# EAGLE board Resistor_Resistor (EAGLE 8.3.0), part 18 of 32
## Placement (x,y rotation side) (continued)
R21730  10K  [0201]  157.02,79.91 0 top
R21731  10K  [0201]  157.02,80.52 0 top
R21732  10K  [0201]  157.02,81.13 0 top
R21733  10K  [0201]  157.02,81.74 0 top
R21734  10K  [0201]  157.02,82.35 0 top
R21735  10K  [0201]  157.02,82.96 0 top
R21736  10K  [0201]  157.02,83.57 0 top
R21737  10K  [0201]  157.02,84.18 0 top
R21738  10K  [0201]  157.02,84.79 0 top
R21739  10K  [0201]  157.02,85.39 0 top
R21740  10K  [0201]  157.02,86 0 top
R21741  10K  [0201]  157.02,86.61 0 top
R21742  10K  [0201]  157.02,87.22 0 top
R21743  10K  [0201]  157.02,87.83 0 top
R21744  10K  [0201]  157.02,88.44 0 top
R21745  10K  [0201]  157.02,89.05 0 top
R21746  10K  [0201]  157.02,89.66 0 top
R21747  10K  [0201]  157.02,90.27 0 top
R21748  10K  [0201]  157.02,90.88 0 top
R21749  10K  [0201]  157.02,91.49 0 top
R21750  10K  [0201]  157.02,92.1 0 top
R21751  10K  [0201]  157.02,92.71 0 top
R21752  10K  [0201]  157.02,93.32 0 top
R21753  10K  [0201]  157.02,93.93 0 top
R21754  10K  [0201]  157.02,94.54 0 top
R21755  10K  [0201]  157.02,95.15 0 top
R21756  10K  [0201]  157.02,95.76 0 top
R21757  10K  [0201]  157.02,96.37 0 top
R21758  10K  [0201]  157.02,96.98 0 top
R21759  10K  [0201]  157.02,97.59 0 top
R21760  10K  [0201]  157.02,98.2 0 top
R21761  10K  [0201]  157.02,98.81 0 top
R21762  10K  [0201]  157.02,99.42 0 top
R21763  10K  [0201]  157.02,100.03 0 top
R21764  10K  [0201]  157.02,100.63 0 top
R21765  10K  [0201]  157.02,101.24 0 top
R21766  10K  [0201]  157.02,101.85 0 top
R21767  10K  [0201]  157.02,102.46 0 top
R21768  10K  [0201]  157.02,103.07 0 top
R21769  10K  [0201]  157.02,103.68 0 top
R21770  10K  [0201]  157.02,104.29 0 top
R21771  10K  [0201]  157.02,104.9 0 top
R21772  10K  [0201]  157.02,105.51 0 top
R21773  10K  [0201]  157.02,106.12 0 top
R21774  10K  [0201]  157.02,106.73 0 top
R21775  10K  [0201]  157.02,107.34 0 top
R21776  10K  [0201]  157.02,107.95 0 top
R21777  10K  [0201]  157.02,108.56 0 top
R21778  10K  [0201]  157.02,109.17 0 top
R21779  10K  [0201]  157.02,109.78 0 top
R21780  10K  [0201]  157.02,110.39 0 top
R21781  10K  [0201]  157.02,111 0 top
R21782  10K  [0201]  157.02,111.61 0 top
R21783  10K  [0201]  157.02,112.22 0 top
R21784  10K  [0201]  157.02,112.83 0 top
R21785  10K  [0201]  157.02,113.44 0 top
R21786  10K  [0201]  157.02,114.05 0 top
R21787  10K  [0201]  157.02,114.66 0 top
R21788  10K  [0201]  157.02,115.27 0 top
R21789  10K  [0201]  157.02,115.87 0 top
R21790  10K  [0201]  157.02,116.48 0 top
R21791  10K  [0201]  157.02,117.09 0 top
R21792  10K  [0201]  157.02,117.7 0 top
R21793  10K  [0201]  157.02,118.31 0 top
R21794  10K  [0201]  157.02,118.92 0 top
R21795  10K  [0201]  157.02,119.53 0 top
R21796  10K  [0201]  157.02,120.14 0 top
R21797  10K  [0201]  157.02,120.75 0 top
R21798  10K  [0201]  157.02,121.36 0 top
R21799  10K  [0201]  157.02,121.97 0 top
R21800  10K  [0201]  157.02,122.58 0 top
R21801  10K  [0201]  158.24,1.27 0 top
R21802  10K  [0201]  158.24,1.88 0 top
R21803  10K  [0201]  158.24,2.49 0 top
R21804  10K  [0201]  158.24,3.1 0 top
R21805  10K  [0201]  158.24,3.71 0 top
R21806  10K  [0201]  158.24,4.32 0 top
R21807  10K  [0201]  158.24,4.93 0 top
R21808  10K  [0201]  158.24,5.54 0 top
R21809  10K  [0201]  158.24,6.15 0 top
R21810  10K  [0201]  158.24,6.76 0 top
R21811  10K  [0201]  158.24,7.37 0 top
R21812  10K  [0201]  158.24,7.98 0 top
R21813  10K  [0201]  158.24,8.59 0 top
R21814  10K  [0201]  158.24,9.19 0 top
R21815  10K  [0201]  158.24,9.8 0 top
R21816  10K  [0201]  158.24,10.41 0 top
R21817  10K  [0201]  158.24,11.02 0 top
R21818  10K  [0201]  158.24,11.63 0 top
R21819  10K  [0201]  158.24,12.24 0 top
R21820  10K  [0201]  158.24,12.85 0 top
R21821  10K  [0201]  158.24,13.46 0 top
R21822  10K  [0201]  158.24,14.07 0 top
R21823  10K  [0201]  158.24,14.68 0 top
R21824  10K  [0201]  158.24,15.29 0 top
R21825  10K  [0201]  158.24,15.9 0 top
R21826  10K  [0201]  158.24,16.51 0 top
R21827  10K  [0201]  158.24,17.12 0 top
R21828  10K  [0201]  158.24,17.73 0 top
R21829  10K  [0201]  158.24,18.34 0 top
R21830  10K  [0201]  158.24,18.95 0 top
R21831  10K  [0201]  158.24,19.56 0 top
R21832  10K  [0201]  158.24,20.17 0 top
R21833  10K  [0201]  158.24,20.78 0 top
R21834  10K  [0201]  158.24,21.39 0 top
R21835  10K  [0201]  158.24,22 0 top
R21836  10K  [0201]  158.24,22.61 0 top
R21837  10K  [0201]  158.24,23.22 0 top
R21838  10K  [0201]  158.24,23.83 0 top
R21839  10K  [0201]  158.24,24.43 0 top
R21840  10K  [0201]  158.24,25.04 0 top
R21841  10K  [0201]  158.24,25.65 0 top
R21842  10K  [0201]  158.24,26.26 0 top
R21843  10K  [0201]  158.24,26.87 0 top
R21844  10K  [0201]  158.24,27.48 0 top
R21845  10K  [0201]  158.24,28.09 0 top
R21846  10K  [0201]  158.24,28.7 0 top
R21847  10K  [0201]  158.24,29.31 0 top
R21848  10K  [0201]  158.24,29.92 0 top
R21849  10K  [0201]  158.24,30.53 0 top
R21850  10K  [0201]  158.24,31.14 0 top
R21851  10K  [0201]  158.24,31.75 0 top
R21852  10K  [0201]  158.24,32.36 0 top
R21853  10K  [0201]  158.24,32.97 0 top
R21854  10K  [0201]  158.24,33.58 0 top
R21855  10K  [0201]  158.24,34.19 0 top
R21856  10K  [0201]  158.24,34.8 0 top
R21857  10K  [0201]  158.24,35.41 0 top
R21858  10K  [0201]  158.24,36.02 0 top
R21859  10K  [0201]  158.24,36.63 0 top
R21860  10K  [0201]  158.24,37.24 0 top
R21861  10K  [0201]  158.24,37.85 0 top
R21862  10K  [0201]  158.24,38.46 0 top
R21863  10K  [0201]  158.24,39.07 0 top
R21864  10K  [0201]  158.24,39.67 0 top
R21865  10K  [0201]  158.24,40.28 0 top
R21866  10K  [0201]  158.24,40.89 0 top
R21867  10K  [0201]  158.24,41.5 0 top
R21868  10K  [0201]  158.24,42.11 0 top
R21869  10K  [0201]  158.24,42.72 0 top
R21870  10K  [0201]  158.24,43.33 0 top
R21871  10K  [0201]  158.24,43.94 0 top
R21872  10K  [0201]  158.24,44.55 0 top
R21873  10K  [0201]  158.24,45.16 0 top
R21874  10K  [0201]  158.24,45.77 0 top
R21875  10K  [0201]  158.24,46.38 0 top
R21876  10K  [0201]  158.24,46.99 0 top
R21877  10K  [0201]  158.24,47.6 0 top
R21878  10K  [0201]  158.24,48.21 0 top
R21879  10K  [0201]  158.24,48.82 0 top
R21880  10K  [0201]  158.24,49.43 0 top
R21881  10K  [0201]  158.24,50.04 0 top
R21882  10K  [0201]  158.24,50.65 0 top
R21883  10K  [0201]  158.24,51.26 0 top
R21884  10K  [0201]  158.24,51.87 0 top
R21885  10K  [0201]  158.24,52.48 0 top
R21886  10K  [0201]  158.24,53.09 0 top
R21887  10K  [0201]  158.24,53.7 0 top
R21888  10K  [0201]  158.24,54.31 0 top
R21889  10K  [0201]  158.24,54.91 0 top
R21890  10K  [0201]  158.24,55.52 0 top
R21891  10K  [0201]  158.24,56.13 0 top
R21892  10K  [0201]  158.24,56.74 0 top
R21893  10K  [0201]  158.24,57.35 0 top
R21894  10K  [0201]  158.24,57.96 0 top
R21895  10K  [0201]  158.24,58.57 0 top
R21896  10K  [0201]  158.24,59.18 0 top
R21897  10K  [0201]  158.24,59.79 0 top
R21898  10K  [0201]  158.24,60.4 0 top
R21899  10K  [0201]  158.24,61.01 0 top
R21900  10K  [0201]  158.24,61.62 0 top
R21901  10K  [0201]  158.24,62.23 0 top
R21902  10K  [0201]  158.24,62.84 0 top
R21903  10K  [0201]  158.24,63.45 0 top
R21904  10K  [0201]  158.24,64.06 0 top
R21905  10K  [0201]  158.24,64.67 0 top
R21906  10K  [0201]  158.24,65.28 0 top
R21907  10K  [0201]  158.24,65.89 0 top
R21908  10K  [0201]  158.24,66.5 0 top
R21909  10K  [0201]  158.24,67.11 0 top
R21910  10K  [0201]  158.24,67.72 0 top
R21911  10K  [0201]  158.24,68.33 0 top
R21912  10K  [0201]  158.24,68.94 0 top
R21913  10K  [0201]  158.24,69.55 0 top
R21914  10K  [0201]  158.24,70.15 0 top
R21915  10K  [0201]  158.24,70.76 0 top
R21916  10K  [0201]  158.24,71.37 0 top
R21917  10K  [0201]  158.24,71.98 0 top
R21918  10K  [0201]  158.24,72.59 0 top
R21919  10K  [0201]  158.24,73.2 0 top
R21920  10K  [0201]  158.24,73.81 0 top
R21921  10K  [0201]  158.24,74.42 0 top
R21922  10K  [0201]  158.24,75.03 0 top
R21923  10K  [0201]  158.24,75.64 0 top
R21924  10K  [0201]  158.24,76.25 0 top
R21925  10K  [0201]  158.24,76.86 0 top
R21926  10K  [0201]  158.24,77.47 0 top
R21927  10K  [0201]  158.24,78.08 0 top
R21928  10K  [0201]  158.24,78.69 0 top
R21929  10K  [0201]  158.24,79.3 0 top
R21930  10K  [0201]  158.24,79.91 0 top
R21931  10K  [0201]  158.24,80.52 0 top
R21932  10K  [0201]  158.24,81.13 0 top
R21933  10K  [0201]  158.24,81.74 0 top
R21934  10K  [0201]  158.24,82.35 0 top
R21935  10K  [0201]  158.24,82.96 0 top
R21936  10K  [0201]  158.24,83.57 0 top
R21937  10K  [0201]  158.24,84.18 0 top
R21938  10K  [0201]  158.24,84.79 0 top
R21939  10K  [0201]  158.24,85.39 0 top
R21940  10K  [0201]  158.24,86 0 top
R21941  10K  [0201]  158.24,86.61 0 top
R21942  10K  [0201]  158.24,87.22 0 top
R21943  10K  [0201]  158.24,87.83 0 top
R21944  10K  [0201]  158.24,88.44 0 top
R21945  10K  [0201]  158.24,89.05 0 top
R21946  10K  [0201]  158.24,89.66 0 top
R21947  10K  [0201]  158.24,90.27 0 top
R21948  10K  [0201]  158.24,90.88 0 top
R21949  10K  [0201]  158.24,91.49 0 top
R21950  10K  [0201]  158.24,92.1 0 top
R21951  10K  [0201]  158.24,92.71 0 top
R21952  10K  [0201]  158.24,93.32 0 top
R21953  10K  [0201]  158.24,93.93 0 top
R21954  10K  [0201]  158.24,94.54 0 top
R21955  10K  [0201]  158.24,95.15 0 top
R21956  10K  [0201]  158.24,95.76 0 top
R21957  10K  [0201]  158.24,96.37 0 top
R21958  10K  [0201]  158.24,96.98 0 top
R21959  10K  [0201]  158.24,97.59 0 top
R21960  10K  [0201]  158.24,98.2 0 top
R21961  10K  [0201]  158.24,98.81 0 top
R21962  10K  [0201]  158.24,99.42 0 top
R21963  10K  [0201]  158.24,100.03 0 top
R21964  10K  [0201]  158.24,100.63 0 top
R21965  10K  [0201]  158.24,101.24 0 top
R21966  10K  [0201]  158.24,101.85 0 top
R21967  10K  [0201]  158.24,102.46 0 top
R21968  10K  [0201]  158.24,103.07 0 top
R21969  10K  [0201]  158.24,103.68 0 top
R21970  10K  [0201]  158.24,104.29 0 top
R21971  10K  [0201]  158.24,104.9 0 top
R21972  10K  [0201]  158.24,105.51 0 top
R21973  10K  [0201]  158.24,106.12 0 top
R21974  10K  [0201]  158.24,106.73 0 top
R21975  10K  [0201]  158.24,107.34 0 top
R21976  10K  [0201]  158.24,107.95 0 top
R21977  10K  [0201]  158.24,108.56 0 top
R21978  10K  [0201]  158.24,109.17 0 top
R21979  10K  [0201]  158.24,109.78 0 top
R21980  10K  [0201]  158.24,110.39 0 top
R21981  10K  [0201]  158.24,111 0 top
R21982  10K  [0201]  158.24,111.61 0 top
R21983  10K  [0201]  158.24,112.22 0 top
R21984  10K  [0201]  158.24,112.83 0 top
R21985  10K  [0201]  158.24,113.44 0 top
R21986  10K  [0201]  158.24,114.05 0 top
R21987  10K  [0201]  158.24,114.66 0 top
R21988  10K  [0201]  158.24,115.27 0 top
R21989  10K  [0201]  158.24,115.87 0 top
R21990  10K  [0201]  158.24,116.48 0 top
R21991  10K  [0201]  158.24,117.09 0 top
R21992  10K  [0201]  158.24,117.7 0 top
R21993  10K  [0201]  158.24,118.31 0 top
R21994  10K  [0201]  158.24,118.92 0 top
R21995  10K  [0201]  158.24,119.53 0 top
R21996  10K  [0201]  158.24,120.14 0 top
R21997  10K  [0201]  158.24,120.75 0 top
R21998  10K  [0201]  158.24,121.36 0 top
R21999  10K  [0201]  158.24,121.97 0 top
R22000  10K  [0201]  158.24,122.58 0 top
R22001  10K  [0201]  159.46,1.27 0 top
R22002  10K  [0201]  159.46,1.88 0 top
R22003  10K  [0201]  159.46,2.49 0 top
R22004  10K  [0201]  159.46,3.1 0 top
R22005  10K  [0201]  159.46,3.71 0 top
R22006  10K  [0201]  159.46,4.32 0 top
R22007  10K  [0201]  159.46,4.93 0 top
R22008  10K  [0201]  159.46,5.54 0 top
R22009  10K  [0201]  159.46,6.15 0 top
R22010  10K  [0201]  159.46,6.76 0 top
R22011  10K  [0201]  159.46,7.37 0 top
R22012  10K  [0201]  159.46,7.98 0 top
R22013  10K  [0201]  159.46,8.59 0 top
R22014  10K  [0201]  159.46,9.19 0 top
R22015  10K  [0201]  159.46,9.8 0 top
R22016  10K  [0201]  159.46,10.41 0 top
R22017  10K  [0201]  159.46,11.02 0 top
R22018  10K  [0201]  159.46,11.63 0 top
R22019  10K  [0201]  159.46,12.24 0 top
R22020  10K  [0201]  159.46,12.85 0 top
R22021  10K  [0201]  159.46,13.46 0 top
R22022  10K  [0201]  159.46,14.07 0 top
R22023  10K  [0201]  159.46,14.68 0 top
R22024  10K  [0201]  159.46,15.29 0 top
R22025  10K  [0201]  159.46,15.9 0 top
R22026  10K  [0201]  159.46,16.51 0 top
R22027  10K  [0201]  159.46,17.12 0 top
R22028  10K  [0201]  159.46,17.73 0 top
R22029  10K  [0201]  159.46,18.34 0 top
R22030  10K  [0201]  159.46,18.95 0 top
R22031  10K  [0201]  159.46,19.56 0 top
R22032  10K  [0201]  159.46,20.17 0 top
R22033  10K  [0201]  159.46,20.78 0 top
R22034  10K  [0201]  159.46,21.39 0 top
R22035  10K  [0201]  159.46,22 0 top
R22036  10K  [0201]  159.46,22.61 0 top
R22037  10K  [0201]  159.46,23.22 0 top
R22038  10K  [0201]  159.46,23.83 0 top
R22039  10K  [0201]  159.46,24.43 0 top
R22040  10K  [0201]  159.46,25.04 0 top
R22041  10K  [0201]  159.46,25.65 0 top
R22042  10K  [0201]  159.46,26.26 0 top
R22043  10K  [0201]  159.46,26.87 0 top
R22044  10K  [0201]  159.46,27.48 0 top
R22045  10K  [0201]  159.46,28.09 0 top
R22046  10K  [0201]  159.46,28.7 0 top
R22047  10K  [0201]  159.46,29.31 0 top
R22048  10K  [0201]  159.46,29.92 0 top
R22049  10K  [0201]  159.46,30.53 0 top
R22050  10K  [0201]  159.46,31.14 0 top
R22051  10K  [0201]  159.46,31.75 0 top
R22052  10K  [0201]  159.46,32.36 0 top
R22053  10K  [0201]  159.46,32.97 0 top
R22054  10K  [0201]  159.46,33.58 0 top
R22055  10K  [0201]  159.46,34.19 0 top
R22056  10K  [0201]  159.46,34.8 0 top
R22057  10K  [0201]  159.46,35.41 0 top
R22058  10K  [0201]  159.46,36.02 0 top
R22059  10K  [0201]  159.46,36.63 0 top
R22060  10K  [0201]  159.46,37.24 0 top
R22061  10K  [0201]  159.46,37.85 0 top
R22062  10K  [0201]  159.46,38.46 0 top
R22063  10K  [0201]  159.46,39.07 0 top
R22064  10K  [0201]  159.46,39.67 0 top
R22065  10K  [0201]  159.46,40.28 0 top
R22066  10K  [0201]  159.46,40.89 0 top
R22067  10K  [0201]  159.46,41.5 0 top
R22068  10K  [0201]  159.46,42.11 0 top
R22069  10K  [0201]  159.46,42.72 0 top
R22070  10K  [0201]  159.46,43.33 0 top
R22071  10K  [0201]  159.46,43.94 0 top
R22072  10K  [0201]  159.46,44.55 0 top
R22073  10K  [0201]  159.46,45.16 0 top
R22074  10K  [0201]  159.46,45.77 0 top
R22075  10K  [0201]  159.46,46.38 0 top
R22076  10K  [0201]  159.46,46.99 0 top
R22077  10K  [0201]  159.46,47.6 0 top
R22078  10K  [0201]  159.46,48.21 0 top
R22079  10K  [0201]  159.46,48.82 0 top
R22080  10K  [0201]  159.46,49.43 0 top
R22081  10K  [0201]  159.46,50.04 0 top
R22082  10K  [0201]  159.46,50.65 0 top
R22083  10K  [0201]  159.46,51.26 0 top
R22084  10K  [0201]  159.46,51.87 0 top
R22085  10K  [0201]  159.46,52.48 0 top
R22086  10K  [0201]  159.46,53.09 0 top
R22087  10K  [0201]  159.46,53.7 0 top
R22088  10K  [0201]  159.46,54.31 0 top
R22089  10K  [0201]  159.46,54.91 0 top
R22090  10K  [0201]  159.46,55.52 0 top
R22091  10K  [0201]  159.46,56.13 0 top
R22092  10K  [0201]  159.46,56.74 0 top
R22093  10K  [0201]  159.46,57.35 0 top
R22094  10K  [0201]  159.46,57.96 0 top
R22095  10K  [0201]  159.46,58.57 0 top
R22096  10K  [0201]  159.46,59.18 0 top
R22097  10K  [0201]  159.46,59.79 0 top
R22098  10K  [0201]  159.46,60.4 0 top
R22099  10K  [0201]  159.46,61.01 0 top
R22100  10K  [0201]  159.46,61.62 0 top
R22101  10K  [0201]  159.46,62.23 0 top
R22102  10K  [0201]  159.46,62.84 0 top
R22103  10K  [0201]  159.46,63.45 0 top
R22104  10K  [0201]  159.46,64.06 0 top
R22105  10K  [0201]  159.46,64.67 0 top
R22106  10K  [0201]  159.46,65.28 0 top
R22107  10K  [0201]  159.46,65.89 0 top
R22108  10K  [0201]  159.46,66.5 0 top
R22109  10K  [0201]  159.46,67.11 0 top
R22110  10K  [0201]  159.46,67.72 0 top
R22111  10K  [0201]  159.46,68.33 0 top
R22112  10K  [0201]  159.46,68.94 0 top
R22113  10K  [0201]  159.46,69.55 0 top
R22114  10K  [0201]  159.46,70.15 0 top
R22115  10K  [0201]  159.46,70.76 0 top
R22116  10K  [0201]  159.46,71.37 0 top
R22117  10K  [0201]  159.46,71.98 0 top
R22118  10K  [0201]  159.46,72.59 0 top
R22119  10K  [0201]  159.46,73.2 0 top
R22120  10K  [0201]  159.46,73.81 0 top
R22121  10K  [0201]  159.46,74.42 0 top
R22122  10K  [0201]  159.46,75.03 0 top
R22123  10K  [0201]  159.46,75.64 0 top
R22124  10K  [0201]  159.46,76.25 0 top
R22125  10K  [0201]  159.46,76.86 0 top
R22126  10K  [0201]  159.46,77.47 0 top
R22127  10K  [0201]  159.46,78.08 0 top
R22128  10K  [0201]  159.46,78.69 0 top
R22129  10K  [0201]  159.46,79.3 0 top
R22130  10K  [0201]  159.46,79.91 0 top
R22131  10K  [0201]  159.46,80.52 0 top
R22132  10K  [0201]  159.46,81.13 0 top
R22133  10K  [0201]  159.46,81.74 0 top
R22134  10K  [0201]  159.46,82.35 0 top
R22135  10K  [0201]  159.46,82.96 0 top
R22136  10K  [0201]  159.46,83.57 0 top
R22137  10K  [0201]  159.46,84.18 0 top
R22138  10K  [0201]  159.46,84.79 0 top
R22139  10K  [0201]  159.46,85.39 0 top
R22140  10K  [0201]  159.46,86 0 top
R22141  10K  [0201]  159.46,86.61 0 top
R22142  10K  [0201]  159.46,87.22 0 top
R22143  10K  [0201]  159.46,87.83 0 top
R22144  10K  [0201]  159.46,88.44 0 top
R22145  10K  [0201]  159.46,89.05 0 top
R22146  10K  [0201]  159.46,89.66 0 top
R22147  10K  [0201]  159.46,90.27 0 top
R22148  10K  [0201]  159.46,90.88 0 top
R22149  10K  [0201]  159.46,91.49 0 top
R22150  10K  [0201]  159.46,92.1 0 top
R22151  10K  [0201]  159.46,92.71 0 top
R22152  10K  [0201]  159.46,93.32 0 top
R22153  10K  [0201]  159.46,93.93 0 top
R22154  10K  [0201]  159.46,94.54 0 top
R22155  10K  [0201]  159.46,95.15 0 top
R22156  10K  [0201]  159.46,95.76 0 top
R22157  10K  [0201]  159.46,96.37 0 top
R22158  10K  [0201]  159.46,96.98 0 top
R22159  10K  [0201]  159.46,97.59 0 top
R22160  10K  [0201]  159.46,98.2 0 top
R22161  10K  [0201]  159.46,98.81 0 top
R22162  10K  [0201]  159.46,99.42 0 top
R22163  10K  [0201]  159.46,100.03 0 top
R22164  10K  [0201]  159.46,100.63 0 top
R22165  10K  [0201]  159.46,101.24 0 top
R22166  10K  [0201]  159.46,101.85 0 top
R22167  10K  [0201]  159.46,102.46 0 top
R22168  10K  [0201]  159.46,103.07 0 top
R22169  10K  [0201]  159.46,103.68 0 top
R22170  10K  [0201]  159.46,104.29 0 top
R22171  10K  [0201]  159.46,104.9 0 top
R22172  10K  [0201]  159.46,105.51 0 top
R22173  10K  [0201]  159.46,106.12 0 top
R22174  10K  [0201]  159.46,106.73 0 top
R22175  10K  [0201]  159.46,107.34 0 top
R22176  10K  [0201]  159.46,107.95 0 top
R22177  10K  [0201]  159.46,108.56 0 top
R22178  10K  [0201]  159.46,109.17 0 top
R22179  10K  [0201]  159.46,109.78 0 top
R22180  10K  [0201]  159.46,110.39 0 top
R22181  10K  [0201]  159.46,111 0 top
R22182  10K  [0201]  159.46,111.61 0 top
R22183  10K  [0201]  159.46,112.22 0 top
R22184  10K  [0201]  159.46,112.83 0 top
R22185  10K  [0201]  159.46,113.44 0 top
R22186  10K  [0201]  159.46,114.05 0 top
R22187  10K  [0201]  159.46,114.66 0 top
R22188  10K  [0201]  159.46,115.27 0 top
R22189  10K  [0201]  159.46,115.87 0 top
R22190  10K  [0201]  159.46,116.48 0 top
R22191  10K  [0201]  159.46,117.09 0 top
R22192  10K  [0201]  159.46,117.7 0 top
R22193  10K  [0201]  159.46,118.31 0 top
R22194  10K  [0201]  159.46,118.92 0 top
R22195  10K  [0201]  159.46,119.53 0 top
R22196  10K  [0201]  159.46,120.14 0 top
R22197  10K  [0201]  159.46,120.75 0 top
R22198  10K  [0201]  159.46,121.36 0 top
R22199  10K  [0201]  159.46,121.97 0 top
R22200  10K  [0201]  159.46,122.58 0 top
R22201  10K  [0201]  160.68,1.27 0 top
R22202  10K  [0201]  160.68,1.88 0 top
R22203  10K  [0201]  160.68,2.49 0 top
R22204  10K  [0201]  160.68,3.1 0 top
R22205  10K  [0201]  160.68,3.71 0 top
R22206  10K  [0201]  160.68,4.32 0 top
R22207  10K  [0201]  160.68,4.93 0 top
R22208  10K  [0201]  160.68,5.54 0 top
R22209  10K  [0201]  160.68,6.15 0 top
R22210  10K  [0201]  160.68,6.76 0 top
R22211  10K  [0201]  160.68,7.37 0 top
R22212  10K  [0201]  160.68,7.98 0 top
R22213  10K  [0201]  160.68,8.59 0 top
R22214  10K  [0201]  160.68,9.19 0 top
R22215  10K  [0201]  160.68,9.8 0 top
R22216  10K  [0201]  160.68,10.41 0 top
R22217  10K  [0201]  160.68,11.02 0 top
R22218  10K  [0201]  160.68,11.63 0 top
R22219  10K  [0201]  160.68,12.24 0 top
R22220  10K  [0201]  160.68,12.85 0 top
R22221  10K  [0201]  160.68,13.46 0 top
R22222  10K  [0201]  160.68,14.07 0 top
R22223  10K  [0201]  160.68,14.68 0 top
R22224  10K  [0201]  160.68,15.29 0 top
R22225  10K  [0201]  160.68,15.9 0 top
R22226  10K  [0201]  160.68,16.51 0 top
R22227  10K  [0201]  160.68,17.12 0 top
R22228  10K  [0201]  160.68,17.73 0 top
R22229  10K  [0201]  160.68,18.34 0 top
R22230  10K  [0201]  160.68,18.95 0 top
R22231  10K  [0201]  160.68,19.56 0 top
R22232  10K  [0201]  160.68,20.17 0 top
R22233  10K  [0201]  160.68,20.78 0 top
R22234  10K  [0201]  160.68,21.39 0 top
R22235  10K  [0201]  160.68,22 0 top
R22236  10K  [0201]  160.68,22.61 0 top
R22237  10K  [0201]  160.68,23.22 0 top
R22238  10K  [0201]  160.68,23.83 0 top
R22239  10K  [0201]  160.68,24.43 0 top
R22240  10K  [0201]  160.68,25.04 0 top
R22241  10K  [0201]  160.68,25.65 0 top
R22242  10K  [0201]  160.68,26.26 0 top
R22243  10K  [0201]  160.68,26.87 0 top
R22244  10K  [0201]  160.68,27.48 0 top
R22245  10K  [0201]  160.68,28.09 0 top
R22246  10K  [0201]  160.68,28.7 0 top
R22247  10K  [0201]  160.68,29.31 0 top
R22248  10K  [0201]  160.68,29.92 0 top
R22249  10K  [0201]  160.68,30.53 0 top
R22250  10K  [0201]  160.68,31.14 0 top
R22251  10K  [0201]  160.68,31.75 0 top
R22252  10K  [0201]  160.68,32.36 0 top
R22253  10K  [0201]  160.68,32.97 0 top
R22254  10K  [0201]  160.68,33.58 0 top
R22255  10K  [0201]  160.68,34.19 0 top
R22256  10K  [0201]  160.68,34.8 0 top
R22257  10K  [0201]  160.68,35.41 0 top
R22258  10K  [0201]  160.68,36.02 0 top
R22259  10K  [0201]  160.68,36.63 0 top
R22260  10K  [0201]  160.68,37.24 0 top
R22261  10K  [0201]  160.68,37.85 0 top
R22262  10K  [0201]  160.68,38.46 0 top
R22263  10K  [0201]  160.68,39.07 0 top
R22264  10K  [0201]  160.68,39.67 0 top
R22265  10K  [0201]  160.68,40.28 0 top
R22266  10K  [0201]  160.68,40.89 0 top
R22267  10K  [0201]  160.68,41.5 0 top
R22268  10K  [0201]  160.68,42.11 0 top
R22269  10K  [0201]  160.68,42.72 0 top
R22270  10K  [0201]  160.68,43.33 0 top
R22271  10K  [0201]  160.68,43.94 0 top
R22272  10K  [0201]  160.68,44.55 0 top
R22273  10K  [0201]  160.68,45.16 0 top
R22274  10K  [0201]  160.68,45.77 0 top
R22275  10K  [0201]  160.68,46.38 0 top
R22276  10K  [0201]  160.68,46.99 0 top
R22277  10K  [0201]  160.68,47.6 0 top
R22278  10K  [0201]  160.68,48.21 0 top
R22279  10K  [0201]  160.68,48.82 0 top
R22280  10K  [0201]  160.68,49.43 0 top
R22281  10K  [0201]  160.68,50.04 0 top
R22282  10K  [0201]  160.68,50.65 0 top
R22283  10K  [0201]  160.68,51.26 0 top
R22284  10K  [0201]  160.68,51.87 0 top
R22285  10K  [0201]  160.68,52.48 0 top
R22286  10K  [0201]  160.68,53.09 0 top
R22287  10K  [0201]  160.68,53.7 0 top
R22288  10K  [0201]  160.68,54.31 0 top
R22289  10K  [0201]  160.68,54.91 0 top
R22290  10K  [0201]  160.68,55.52 0 top
R22291  10K  [0201]  160.68,56.13 0 top
R22292  10K  [0201]  160.68,56.74 0 top
R22293  10K  [0201]  160.68,57.35 0 top
R22294  10K  [0201]  160.68,57.96 0 top
R22295  10K  [0201]  160.68,58.57 0 top
R22296  10K  [0201]  160.68,59.18 0 top
R22297  10K  [0201]  160.68,59.79 0 top
R22298  10K  [0201]  160.68,60.4 0 top
R22299  10K  [0201]  160.68,61.01 0 top
R22300  10K  [0201]  160.68,61.62 0 top
R22301  10K  [0201]  160.68,62.23 0 top
R22302  10K  [0201]  160.68,62.84 0 top
R22303  10K  [0201]  160.68,63.45 0 top
R22304  10K  [0201]  160.68,64.06 0 top
R22305  10K  [0201]  160.68,64.67 0 top
R22306  10K  [0201]  160.68,65.28 0 top
R22307  10K  [0201]  160.68,65.89 0 top
R22308  10K  [0201]  160.68,66.5 0 top
R22309  10K  [0201]  160.68,67.11 0 top
R22310  10K  [0201]  160.68,67.72 0 top
R22311  10K  [0201]  160.68,68.33 0 top
R22312  10K  [0201]  160.68,68.94 0 top
R22313  10K  [0201]  160.68,69.55 0 top
R22314  10K  [0201]  160.68,70.15 0 top
R22315  10K  [0201]  160.68,70.76 0 top
R22316  10K  [0201]  160.68,71.37 0 top
R22317  10K  [0201]  160.68,71.98 0 top
R22318  10K  [0201]  160.68,72.59 0 top
R22319  10K  [0201]  160.68,73.2 0 top
R22320  10K  [0201]  160.68,73.81 0 top
R22321  10K  [0201]  160.68,74.42 0 top
R22322  10K  [0201]  160.68,75.03 0 top
R22323  10K  [0201]  160.68,75.64 0 top
R22324  10K  [0201]  160.68,76.25 0 top
R22325  10K  [0201]  160.68,76.86 0 top
R22326  10K  [0201]  160.68,77.47 0 top
R22327  10K  [0201]  160.68,78.08 0 top
R22328  10K  [0201]  160.68,78.69 0 top
R22329  10K  [0201]  160.68,79.3 0 top
R22330  10K  [0201]  160.68,79.91 0 top
R22331  10K  [0201]  160.68,80.52 0 top
R22332  10K  [0201]  160.68,81.13 0 top
R22333  10K  [0201]  160.68,81.74 0 top
R22334  10K  [0201]  160.68,82.35 0 top
R22335  10K  [0201]  160.68,82.96 0 top
R22336  10K  [0201]  160.68,83.57 0 top
R22337  10K  [0201]  160.68,84.18 0 top
R22338  10K  [0201]  160.68,84.79 0 top
R22339  10K  [0201]  160.68,85.39 0 top
R22340  10K  [0201]  160.68,86 0 top
R22341  10K  [0201]  160.68,86.61 0 top
R22342  10K  [0201]  160.68,87.22 0 top
R22343  10K  [0201]  160.68,87.83 0 top
R22344  10K  [0201]  160.68,88.44 0 top
R22345  10K  [0201]  160.68,89.05 0 top
R22346  10K  [0201]  160.68,89.66 0 top
R22347  10K  [0201]  160.68,90.27 0 top
R22348  10K  [0201]  160.68,90.88 0 top
R22349  10K  [0201]  160.68,91.49 0 top
R22350  10K  [0201]  160.68,92.1 0 top
R22351  10K  [0201]  160.68,92.71 0 top
R22352  10K  [0201]  160.68,93.32 0 top
R22353  10K  [0201]  160.68,93.93 0 top
R22354  10K  [0201]  160.68,94.54 0 top
R22355  10K  [0201]  160.68,95.15 0 top
R22356  10K  [0201]  160.68,95.76 0 top
R22357  10K  [0201]  160.68,96.37 0 top
R22358  10K  [0201]  160.68,96.98 0 top
R22359  10K  [0201]  160.68,97.59 0 top
R22360  10K  [0201]  160.68,98.2 0 top
R22361  10K  [0201]  160.68,98.81 0 top
R22362  10K  [0201]  160.68,99.42 0 top
R22363  10K  [0201]  160.68,100.03 0 top
R22364  10K  [0201]  160.68,100.63 0 top
R22365  10K  [0201]  160.68,101.24 0 top
R22366  10K  [0201]  160.68,101.85 0 top
R22367  10K  [0201]  160.68,102.46 0 top
R22368  10K  [0201]  160.68,103.07 0 top
R22369  10K  [0201]  160.68,103.68 0 top
R22370  10K  [0201]  160.68,104.29 0 top
R22371  10K  [0201]  160.68,104.9 0 top
R22372  10K  [0201]  160.68,105.51 0 top
R22373  10K  [0201]  160.68,106.12 0 top
R22374  10K  [0201]  160.68,106.73 0 top
R22375  10K  [0201]  160.68,107.34 0 top
R22376  10K  [0201]  160.68,107.95 0 top
R22377  10K  [0201]  160.68,108.56 0 top
R22378  10K  [0201]  160.68,109.17 0 top
R22379  10K  [0201]  160.68,109.78 0 top
R22380  10K  [0201]  160.68,110.39 0 top
R22381  10K  [0201]  160.68,111 0 top
R22382  10K  [0201]  160.68,111.61 0 top
R22383  10K  [0201]  160.68,112.22 0 top
R22384  10K  [0201]  160.68,112.83 0 top
R22385  10K  [0201]  160.68,113.44 0 top
R22386  10K  [0201]  160.68,114.05 0 top
R22387  10K  [0201]  160.68,114.66 0 top
R22388  10K  [0201]  160.68,115.27 0 top
R22389  10K  [0201]  160.68,115.87 0 top
R22390  10K  [0201]  160.68,116.48 0 top
R22391  10K  [0201]  160.68,117.09 0 top
R22392  10K  [0201]  160.68,117.7 0 top
R22393  10K  [0201]  160.68,118.31 0 top
R22394  10K  [0201]  160.68,118.92 0 top
R22395  10K  [0201]  160.68,119.53 0 top
R22396  10K  [0201]  160.68,120.14 0 top
R22397  10K  [0201]  160.68,120.75 0 top
R22398  10K  [0201]  160.68,121.36 0 top
R22399  10K  [0201]  160.68,121.97 0 top
R22400  10K  [0201]  160.68,122.58 0 top
R22401  10K  [0201]  161.9,1.27 0 top
R22402  10K  [0201]  161.9,1.88 0 top
R22403  10K  [0201]  161.9,2.49 0 top
R22404  10K  [0201]  161.9,3.1 0 top
R22405  10K  [0201]  161.9,3.71 0 top
R22406  10K  [0201]  161.9,4.32 0 top
R22407  10K  [0201]  161.9,4.93 0 top
R22408  10K  [0201]  161.9,5.54 0 top
R22409  10K  [0201]  161.9,6.15 0 top
R22410  10K  [0201]  161.9,6.76 0 top
R22411  10K  [0201]  161.9,7.37 0 top
R22412  10K  [0201]  161.9,7.98 0 top
R22413  10K  [0201]  161.9,8.59 0 top
R22414  10K  [0201]  161.9,9.19 0 top
R22415  10K  [0201]  161.9,9.8 0 top
R22416  10K  [0201]  161.9,10.41 0 top
R22417  10K  [0201]  161.9,11.02 0 top
R22418  10K  [0201]  161.9,11.63 0 top
R22419  10K  [0201]  161.9,12.24 0 top
R22420  10K  [0201]  161.9,12.85 0 top
R22421  10K  [0201]  161.9,13.46 0 top
R22422  10K  [0201]  161.9,14.07 0 top
R22423  10K  [0201]  161.9,14.68 0 top
R22424  10K  [0201]  161.9,15.29 0 top
R22425  10K  [0201]  161.9,15.9 0 top
R22426  10K  [0201]  161.9,16.51 0 top
R22427  10K  [0201]  161.9,17.12 0 top
R22428  10K  [0201]  161.9,17.73 0 top
R22429  10K  [0201]  161.9,18.34 0 top
R22430  10K  [0201]  161.9,18.95 0 top
R22431  10K  [0201]  161.9,19.56 0 top
R22432  10K  [0201]  161.9,20.17 0 top
R22433  10K  [0201]  161.9,20.78 0 top
R22434  10K  [0201]  161.9,21.39 0 top
R22435  10K  [0201]  161.9,22 0 top
R22436  10K  [0201]  161.9,22.61 0 top
R22437  10K  [0201]  161.9,23.22 0 top
R22438  10K  [0201]  161.9,23.83 0 top
R22439  10K  [0201]  161.9,24.43 0 top
R22440  10K  [0201]  161.9,25.04 0 top
R22441  10K  [0201]  161.9,25.65 0 top
R22442  10K  [0201]  161.9,26.26 0 top
R22443  10K  [0201]  161.9,26.87 0 top
R22444  10K  [0201]  161.9,27.48 0 top
R22445  10K  [0201]  161.9,28.09 0 top
R22446  10K  [0201]  161.9,28.7 0 top
R22447  10K  [0201]  161.9,29.31 0 top
R22448  10K  [0201]  161.9,29.92 0 top
R22449  10K  [0201]  161.9,30.53 0 top
R22450  10K  [0201]  161.9,31.14 0 top
R22451  10K  [0201]  161.9,31.75 0 top
R22452  10K  [0201]  161.9,32.36 0 top
R22453  10K  [0201]  161.9,32.97 0 top
R22454  10K  [0201]  161.9,33.58 0 top
R22455  10K  [0201]  161.9,34.19 0 top
R22456  10K  [0201]  161.9,34.8 0 top
R22457  10K  [0201]  161.9,35.41 0 top
R22458  10K  [0201]  161.9,36.02 0 top
R22459  10K  [0201]  161.9,36.63 0 top
R22460  10K  [0201]  161.9,37.24 0 top
R22461  10K  [0201]  161.9,37.85 0 top
R22462  10K  [0201]  161.9,38.46 0 top
R22463  10K  [0201]  161.9,39.07 0 top
R22464  10K  [0201]  161.9,39.67 0 top
R22465  10K  [0201]  161.9,40.28 0 top
R22466  10K  [0201]  161.9,40.89 0 top
R22467  10K  [0201]  161.9,41.5 0 top
R22468  10K  [0201]  161.9,42.11 0 top
R22469  10K  [0201]  161.9,42.72 0 top
R22470  10K  [0201]  161.9,43.33 0 top
R22471  10K  [0201]  161.9,43.94 0 top
R22472  10K  [0201]  161.9,44.55 0 top
R22473  10K  [0201]  161.9,45.16 0 top
R22474  10K  [0201]  161.9,45.77 0 top
R22475  10K  [0201]  161.9,46.38 0 top
R22476  10K  [0201]  161.9,46.99 0 top
R22477  10K  [0201]  161.9,47.6 0 top
R22478  10K  [0201]  161.9,48.21 0 top
R22479  10K  [0201]  161.9,48.82 0 top
R22480  10K  [0201]  161.9,49.43 0 top
R22481  10K  [0201]  161.9,50.04 0 top
R22482  10K  [0201]  161.9,50.65 0 top
R22483  10K  [0201]  161.9,51.26 0 top
R22484  10K  [0201]  161.9,51.87 0 top
R22485  10K  [0201]  161.9,52.48 0 top
R22486  10K  [0201]  161.9,53.09 0 top
R22487  10K  [0201]  161.9,53.7 0 top
R22488  10K  [0201]  161.9,54.31 0 top
R22489  10K  [0201]  161.9,54.91 0 top
R22490  10K  [0201]  161.9,55.52 0 top
R22491  10K  [0201]  161.9,56.13 0 top
R22492  10K  [0201]  161.9,56.74 0 top
R22493  10K  [0201]  161.9,57.35 0 top
R22494  10K  [0201]  161.9,57.96 0 top
R22495  10K  [0201]  161.9,58.57 0 top
R22496  10K  [0201]  161.9,59.18 0 top
R22497  10K  [0201]  161.9,59.79 0 top
R22498  10K  [0201]  161.9,60.4 0 top
R22499  10K  [0201]  161.9,61.01 0 top
R22500  10K  [0201]  161.9,61.62 0 top
R22501  10K  [0201]  161.9,62.23 0 top
R22502  10K  [0201]  161.9,62.84 0 top
R22503  10K  [0201]  161.9,63.45 0 top
R22504  10K  [0201]  161.9,64.06 0 top
R22505  10K  [0201]  161.9,64.67 0 top
R22506  10K  [0201]  161.9,65.28 0 top
R22507  10K  [0201]  161.9,65.89 0 top
R22508  10K  [0201]  161.9,66.5 0 top
R22509  10K  [0201]  161.9,67.11 0 top
R22510  10K  [0201]  161.9,67.72 0 top
R22511  10K  [0201]  161.9,68.33 0 top
R22512  10K  [0201]  161.9,68.94 0 top
R22513  10K  [0201]  161.9,69.55 0 top
R22514  10K  [0201]  161.9,70.15 0 top
R22515  10K  [0201]  161.9,70.76 0 top
R22516  10K  [0201]  161.9,71.37 0 top
R22517  10K  [0201]  161.9,71.98 0 top
R22518  10K  [0201]  161.9,72.59 0 top
R22519  10K  [0201]  161.9,73.2 0 top
R22520  10K  [0201]  161.9,73.81 0 top
R22521  10K  [0201]  161.9,74.42 0 top
R22522  10K  [0201]  161.9,75.03 0 top
R22523  10K  [0201]  161.9,75.64 0 top
R22524  10K  [0201]  161.9,76.25 0 top
R22525  10K  [0201]  161.9,76.86 0 top
R22526  10K  [0201]  161.9,77.47 0 top
R22527  10K  [0201]  161.9,78.08 0 top
R22528  10K  [0201]  161.9,78.69 0 top
R22529  10K  [0201]  161.9,79.3 0 top
R22530  10K  [0201]  161.9,79.91 0 top
R22531  10K  [0201]  161.9,80.52 0 top
R22532  10K  [0201]  161.9,81.13 0 top
R22533  10K  [0201]  161.9,81.74 0 top
R22534  10K  [0201]  161.9,82.35 0 top
R22535  10K  [0201]  161.9,82.96 0 top
R22536  10K  [0201]  161.9,83.57 0 top
R22537  10K  [0201]  161.9,84.18 0 top
R22538  10K  [0201]  161.9,84.79 0 top
R22539  10K  [0201]  161.9,85.39 0 top
R22540  10K  [0201]  161.9,86 0 top
R22541  10K  [0201]  161.9,86.61 0 top
R22542  10K  [0201]  161.9,87.22 0 top
R22543  10K  [0201]  161.9,87.83 0 top
R22544  10K  [0201]  161.9,88.44 0 top
R22545  10K  [0201]  161.9,89.05 0 top
R22546  10K  [0201]  161.9,89.66 0 top
R22547  10K  [0201]  161.9,90.27 0 top
R22548  10K  [0201]  161.9,90.88 0 top
R22549  10K  [0201]  161.9,91.49 0 top
R22550  10K  [0201]  161.9,92.1 0 top
R22551  10K  [0201]  161.9,92.71 0 top
R22552  10K  [0201]  161.9,93.32 0 top
R22553  10K  [0201]  161.9,93.93 0 top
R22554  10K  [0201]  161.9,94.54 0 top
R22555  10K  [0201]  161.9,95.15 0 top
R22556  10K  [0201]  161.9,95.76 0 top
R22557  10K  [0201]  161.9,96.37 0 top
R22558  10K  [0201]  161.9,96.98 0 top
R22559  10K  [0201]  161.9,97.59 0 top
R22560  10K  [0201]  161.9,98.2 0 top
R22561  10K  [0201]  161.9,98.81 0 top
R22562  10K  [0201]  161.9,99.42 0 top
R22563  10K  [0201]  161.9,100.03 0 top
R22564  10K  [0201]  161.9,100.63 0 top
R22565  10K  [0201]  161.9,101.24 0 top
R22566  10K  [0201]  161.9,101.85 0 top
R22567  10K  [0201]  161.9,102.46 0 top
R22568  10K  [0201]  161.9,103.07 0 top
R22569  10K  [0201]  161.9,103.68 0 top
R22570  10K  [0201]  161.9,104.29 0 top
R22571  10K  [0201]  161.9,104.9 0 top
R22572  10K  [0201]  161.9,105.51 0 top
R22573  10K  [0201]  161.9,106.12 0 top
R22574  10K  [0201]  161.9,106.73 0 top
R22575  10K  [0201]  161.9,107.34 0 top
R22576  10K  [0201]  161.9,107.95 0 top
R22577  10K  [0201]  161.9,108.56 0 top
R22578  10K  [0201]  161.9,109.17 0 top
R22579  10K  [0201]  161.9,109.78 0 top
R22580  10K  [0201]  161.9,110.39 0 top
R22581  10K  [0201]  161.9,111 0 top
R22582  10K  [0201]  161.9,111.61 0 top
R22583  10K  [0201]  161.9,112.22 0 top
R22584  10K  [0201]  161.9,112.83 0 top
R22585  10K  [0201]  161.9,113.44 0 top
R22586  10K  [0201]  161.9,114.05 0 top
R22587  10K  [0201]  161.9,114.66 0 top
R22588  10K  [0201]  161.9,115.27 0 top
R22589  10K  [0201]  161.9,115.87 0 top
R22590  10K  [0201]  161.9,116.48 0 top
R22591  10K  [0201]  161.9,117.09 0 top
R22592  10K  [0201]  161.9,117.7 0 top
R22593  10K  [0201]  161.9,118.31 0 top
R22594  10K  [0201]  161.9,118.92 0 top
R22595  10K  [0201]  161.9,119.53 0 top
R22596  10K  [0201]  161.9,120.14 0 top
R22597  10K  [0201]  161.9,120.75 0 top
R22598  10K  [0201]  161.9,121.36 0 top
R22599  10K  [0201]  161.9,121.97 0 top
R22600  10K  [0201]  161.9,122.58 0 top
R22601  10K  [0201]  163.12,1.27 0 top
R22602  10K  [0201]  163.12,1.88 0 top
R22603  10K  [0201]  163.12,2.49 0 top
R22604  10K  [0201]  163.12,3.1 0 top
R22605  10K  [0201]  163.12,3.71 0 top
R22606  10K  [0201]  163.12,4.32 0 top
R22607  10K  [0201]  163.12,4.93 0 top
R22608  10K  [0201]  163.12,5.54 0 top
R22609  10K  [0201]  163.12,6.15 0 top
R22610  10K  [0201]  163.12,6.76 0 top
R22611  10K  [0201]  163.12,7.37 0 top
R22612  10K  [0201]  163.12,7.98 0 top
R22613  10K  [0201]  163.12,8.59 0 top
R22614  10K  [0201]  163.12,9.19 0 top
R22615  10K  [0201]  163.12,9.8 0 top
R22616  10K  [0201]  163.12,10.41 0 top
R22617  10K  [0201]  163.12,11.02 0 top
R22618  10K  [0201]  163.12,11.63 0 top
R22619  10K  [0201]  163.12,12.24 0 top
R22620  10K  [0201]  163.12,12.85 0 top
R22621  10K  [0201]  163.12,13.46 0 top
R22622  10K  [0201]  163.12,14.07 0 top
R22623  10K  [0201]  163.12,14.68 0 top
R22624  10K  [0201]  163.12,15.29 0 top
R22625  10K  [0201]  163.12,15.9 0 top
R22626  10K  [0201]  163.12,16.51 0 top
R22627  10K  [0201]  163.12,17.12 0 top
R22628  10K  [0201]  163.12,17.73 0 top
R22629  10K  [0201]  163.12,18.34 0 top
R22630  10K  [0201]  163.12,18.95 0 top
R22631  10K  [0201]  163.12,19.56 0 top
R22632  10K  [0201]  163.12,20.17 0 top
R22633  10K  [0201]  163.12,20.78 0 top
R22634  10K  [0201]  163.12,21.39 0 top
R22635  10K  [0201]  163.12,22 0 top
R22636  10K  [0201]  163.12,22.61 0 top
R22637  10K  [0201]  163.12,23.22 0 top
R22638  10K  [0201]  163.12,23.83 0 top
R22639  10K  [0201]  163.12,24.43 0 top
R22640  10K  [0201]  163.12,25.04 0 top
R22641  10K  [0201]  163.12,25.65 0 top
R22642  10K  [0201]  163.12,26.26 0 top
R22643  10K  [0201]  163.12,26.87 0 top
R22644  10K  [0201]  163.12,27.48 0 top
R22645  10K  [0201]  163.12,28.09 0 top
R22646  10K  [0201]  163.12,28.7 0 top
R22647  10K  [0201]  163.12,29.31 0 top
R22648  10K  [0201]  163.12,29.92 0 top
R22649  10K  [0201]  163.12,30.53 0 top
R22650  10K  [0201]  163.12,31.14 0 top
R22651  10K  [0201]  163.12,31.75 0 top
R22652  10K  [0201]  163.12,32.36 0 top
R22653  10K  [0201]  163.12,32.97 0 top
R22654  10K  [0201]  163.12,33.58 0 top
R22655  10K  [0201]  163.12,34.19 0 top
R22656  10K  [0201]  163.12,34.8 0 top
R22657  10K  [0201]  163.12,35.41 0 top
R22658  10K  [0201]  163.12,36.02 0 top
R22659  10K  [0201]  163.12,36.63 0 top
R22660  10K  [0201]  163.12,37.24 0 top
R22661  10K  [0201]  163.12,37.85 0 top
R22662  10K  [0201]  163.12,38.46 0 top
R22663  10K  [0201]  163.12,39.07 0 top
R22664  10K  [0201]  163.12,39.67 0 top
R22665  10K  [0201]  163.12,40.28 0 top
R22666  10K  [0201]  163.12,40.89 0 top
R22667  10K  [0201]  163.12,41.5 0 top
R22668  10K  [0201]  163.12,42.11 0 top
R22669  10K  [0201]  163.12,42.72 0 top
R22670  10K  [0201]  163.12,43.33 0 top
R22671  10K  [0201]  163.12,43.94 0 top
R22672  10K  [0201]  163.12,44.55 0 top
R22673  10K  [0201]  163.12,45.16 0 top
R22674  10K  [0201]  163.12,45.77 0 top
R22675  10K  [0201]  163.12,46.38 0 top
R22676  10K  [0201]  163.12,46.99 0 top
R22677  10K  [0201]  163.12,47.6 0 top
R22678  10K  [0201]  163.12,48.21 0 top
R22679  10K  [0201]  163.12,48.82 0 top
R22680  10K  [0201]  163.12,49.43 0 top
R22681  10K  [0201]  163.12,50.04 0 top
R22682  10K  [0201]  163.12,50.65 0 top
R22683  10K  [0201]  163.12,51.26 0 top
R22684  10K  [0201]  163.12,51.87 0 top
R22685  10K  [0201]  163.12,52.48 0 top
R22686  10K  [0201]  163.12,53.09 0 top
R22687  10K  [0201]  163.12,53.7 0 top
R22688  10K  [0201]  163.12,54.31 0 top
R22689  10K  [0201]  163.12,54.91 0 top
R22690  10K  [0201]  163.12,55.52 0 top
R22691  10K  [0201]  163.12,56.13 0 top
R22692  10K  [0201]  163.12,56.74 0 top
R22693  10K  [0201]  163.12,57.35 0 top
R22694  10K  [0201]  163.12,57.96 0 top
R22695  10K  [0201]  163.12,58.57 0 top
R22696  10K  [0201]  163.12,59.18 0 top
R22697  10K  [0201]  163.12,59.79 0 top
R22698  10K  [0201]  163.12,60.4 0 top
R22699  10K  [0201]  163.12,61.01 0 top
R22700  10K  [0201]  163.12,61.62 0 top
R22701  10K  [0201]  163.12,62.23 0 top
R22702  10K  [0201]  163.12,62.84 0 top
R22703  10K  [0201]  163.12,63.45 0 top
R22704  10K  [0201]  163.12,64.06 0 top
R22705  10K  [0201]  163.12,64.67 0 top
R22706  10K  [0201]  163.12,65.28 0 top
R22707  10K  [0201]  163.12,65.89 0 top
R22708  10K  [0201]  163.12,66.5 0 top
R22709  10K  [0201]  163.12,67.11 0 top
R22710  10K  [0201]  163.12,67.72 0 top
R22711  10K  [0201]  163.12,68.33 0 top
R22712  10K  [0201]  163.12,68.94 0 top
R22713  10K  [0201]  163.12,69.55 0 top
R22714  10K  [0201]  163.12,70.15 0 top
R22715  10K  [0201]  163.12,70.76 0 top
R22716  10K  [0201]  163.12,71.37 0 top
R22717  10K  [0201]  163.12,71.98 0 top
R22718  10K  [0201]  163.12,72.59 0 top
R22719  10K  [0201]  163.12,73.2 0 top
R22720  10K  [0201]  163.12,73.81 0 top
R22721  10K  [0201]  163.12,74.42 0 top
R22722  10K  [0201]  163.12,75.03 0 top
R22723  10K  [0201]  163.12,75.64 0 top
R22724  10K  [0201]  163.12,76.25 0 top
R22725  10K  [0201]  163.12,76.86 0 top
R22726  10K  [0201]  163.12,77.47 0 top
R22727  10K  [0201]  163.12,78.08 0 top
R22728  10K  [0201]  163.12,78.69 0 top
R22729  10K  [0201]  163.12,79.3 0 top
R22730  10K  [0201]  163.12,79.91 0 top
R22731  10K  [0201]  163.12,80.52 0 top
R22732  10K  [0201]  163.12,81.13 0 top
R22733  10K  [0201]  163.12,81.74 0 top
R22734  10K  [0201]  163.12,82.35 0 top
R22735  10K  [0201]  163.12,82.96 0 top
R22736  10K  [0201]  163.12,83.57 0 top
R22737  10K  [0201]  163.12,84.18 0 top
R22738  10K  [0201]  163.12,84.79 0 top
R22739  10K  [0201]  163.12,85.39 0 top
R22740  10K  [0201]  163.12,86 0 top
R22741  10K  [0201]  163.12,86.61 0 top
R22742  10K  [0201]  163.12,87.22 0 top
R22743  10K  [0201]  163.12,87.83 0 top
R22744  10K  [0201]  163.12,88.44 0 top
R22745  10K  [0201]  163.12,89.05 0 top
R22746  10K  [0201]  163.12,89.66 0 top
R22747  10K  [0201]  163.12,90.27 0 top
R22748  10K  [0201]  163.12,90.88 0 top
R22749  10K  [0201]  163.12,91.49 0 top
R22750  10K  [0201]  163.12,92.1 0 top
R22751  10K  [0201]  163.12,92.71 0 top
R22752  10K  [0201]  163.12,93.32 0 top
R22753  10K  [0201]  163.12,93.93 0 top
R22754  10K  [0201]  163.12,94.54 0 top
R22755  10K  [0201]  163.12,95.15 0 top
R22756  10K  [0201]  163.12,95.76 0 top
R22757  10K  [0201]  163.12,96.37 0 top
R22758  10K  [0201]  163.12,96.98 0 top
R22759  10K  [0201]  163.12,97.59 0 top
R22760  10K  [0201]  163.12,98.2 0 top
R22761  10K  [0201]  163.12,98.81 0 top
R22762  10K  [0201]  163.12,99.42 0 top
R22763  10K  [0201]  163.12,100.03 0 top
R22764  10K  [0201]  163.12,100.63 0 top
R22765  10K  [0201]  163.12,101.24 0 top
R22766  10K  [0201]  163.12,101.85 0 top
R22767  10K  [0201]  163.12,102.46 0 top
R22768  10K  [0201]  163.12,103.07 0 top
R22769  10K  [0201]  163.12,103.68 0 top
R22770  10K  [0201]  163.12,104.29 0 top
R22771  10K  [0201]  163.12,104.9 0 top
R22772  10K  [0201]  163.12,105.51 0 top
R22773  10K  [0201]  163.12,106.12 0 top
R22774  10K  [0201]  163.12,106.73 0 top
R22775  10K  [0201]  163.12,107.34 0 top
R22776  10K  [0201]  163.12,107.95 0 top
R22777  10K  [0201]  163.12,108.56 0 top
R22778  10K  [0201]  163.12,109.17 0 top
R22779  10K  [0201]  163.12,109.78 0 top
R22780  10K  [0201]  163.12,110.39 0 top
R22781  10K  [0201]  163.12,111 0 top
R22782  10K  [0201]  163.12,111.61 0 top
R22783  10K  [0201]  163.12,112.22 0 top
R22784  10K  [0201]  163.12,112.83 0 top
R22785  10K  [0201]  163.12,113.44 0 top
R22786  10K  [0201]  163.12,114.05 0 top
R22787  10K  [0201]  163.12,114.66 0 top
R22788  10K  [0201]  163.12,115.27 0 top
R22789  10K  [0201]  163.12,115.87 0 top
R22790  10K  [0201]  163.12,116.48 0 top
R22791  10K  [0201]  163.12,117.09 0 top
R22792  10K  [0201]  163.12,117.7 0 top
R22793  10K  [0201]  163.12,118.31 0 top
R22794  10K  [0201]  163.12,118.92 0 top
R22795  10K  [0201]  163.12,119.53 0 top
R22796  10K  [0201]  163.12,120.14 0 top
R22797  10K  [0201]  163.12,120.75 0 top
R22798  10K  [0201]  163.12,121.36 0 top
R22799  10K  [0201]  163.12,121.97 0 top
R22800  10K  [0201]  163.12,122.58 0 top
R22801  10K  [0201]  164.34,1.27 0 top
R22802  10K  [0201]  164.34,1.88 0 top
R22803  10K  [0201]  164.34,2.49 0 top
R22804  10K  [0201]  164.34,3.1 0 top
R22805  10K  [0201]  164.34,3.71 0 top
R22806  10K  [0201]  164.34,4.32 0 top
R22807  10K  [0201]  164.34,4.93 0 top
R22808  10K  [0201]  164.34,5.54 0 top
R22809  10K  [0201]  164.34,6.15 0 top
R22810  10K  [0201]  164.34,6.76 0 top
R22811  10K  [0201]  164.34,7.37 0 top
R22812  10K  [0201]  164.34,7.98 0 top
R22813  10K  [0201]  164.34,8.59 0 top
R22814  10K  [0201]  164.34,9.19 0 top
R22815  10K  [0201]  164.34,9.8 0 top
R22816  10K  [0201]  164.34,10.41 0 top
R22817  10K  [0201]  164.34,11.02 0 top
R22818  10K  [0201]  164.34,11.63 0 top
R22819  10K  [0201]  164.34,12.24 0 top
R22820  10K  [0201]  164.34,12.85 0 top
R22821  10K  [0201]  164.34,13.46 0 top
R22822  10K  [0201]  164.34,14.07 0 top
R22823  10K  [0201]  164.34,14.68 0 top
R22824  10K  [0201]  164.34,15.29 0 top
R22825  10K  [0201]  164.34,15.9 0 top
R22826  10K  [0201]  164.34,16.51 0 top
R22827  10K  [0201]  164.34,17.12 0 top
R22828  10K  [0201]  164.34,17.73 0 top
R22829  10K  [0201]  164.34,18.34 0 top
R22830  10K  [0201]  164.34,18.95 0 top
R22831  10K  [0201]  164.34,19.56 0 top
R22832  10K  [0201]  164.34,20.17 0 top
R22833  10K  [0201]  164.34,20.78 0 top
R22834  10K  [0201]  164.34,21.39 0 top
R22835  10K  [0201]  164.34,22 0 top
R22836  10K  [0201]  164.34,22.61 0 top
R22837  10K  [0201]  164.34,23.22 0 top
R22838  10K  [0201]  164.34,23.83 0 top
R22839  10K  [0201]  164.34,24.43 0 top
R22840  10K  [0201]  164.34,25.04 0 top
R22841  10K  [0201]  164.34,25.65 0 top
R22842  10K  [0201]  164.34,26.26 0 top
R22843  10K  [0201]  164.34,26.87 0 top
R22844  10K  [0201]  164.34,27.48 0 top
R22845  10K  [0201]  164.34,28.09 0 top
R22846  10K  [0201]  164.34,28.7 0 top
R22847  10K  [0201]  164.34,29.31 0 top
R22848  10K  [0201]  164.34,29.92 0 top
R22849  10K  [0201]  164.34,30.53 0 top
R22850  10K  [0201]  164.34,31.14 0 top
R22851  10K  [0201]  164.34,31.75 0 top
R22852  10K  [0201]  164.34,32.36 0 top
R22853  10K  [0201]  164.34,32.97 0 top
R22854  10K  [0201]  164.34,33.58 0 top
R22855  10K  [0201]  164.34,34.19 0 top
R22856  10K  [0201]  164.34,34.8 0 top
R22857  10K  [0201]  164.34,35.41 0 top
R22858  10K  [0201]  164.34,36.02 0 top
R22859  10K  [0201]  164.34,36.63 0 top
R22860  10K  [0201]  164.34,37.24 0 top
R22861  10K  [0201]  164.34,37.85 0 top
R22862  10K  [0201]  164.34,38.46 0 top
R22863  10K  [0201]  164.34,39.07 0 top
R22864  10K  [0201]  164.34,39.67 0 top
R22865  10K  [0201]  164.34,40.28 0 top
R22866  10K  [0201]  164.34,40.89 0 top
R22867  10K  [0201]  164.34,41.5 0 top
R22868  10K  [0201]  164.34,42.11 0 top
R22869  10K  [0201]  164.34,42.72 0 top
R22870  10K  [0201]  164.34,43.33 0 top
R22871  10K  [0201]  164.34,43.94 0 top
R22872  10K  [0201]  164.34,44.55 0 top
R22873  10K  [0201]  164.34,45.16 0 top
R22874  10K  [0201]  164.34,45.77 0 top
R22875  10K  [0201]  164.34,46.38 0 top
R22876  10K  [0201]  164.34,46.99 0 top
R22877  10K  [0201]  164.34,47.6 0 top
R22878  10K  [0201]  164.34,48.21 0 top
R22879  10K  [0201]  164.34,48.82 0 top
R22880  10K  [0201]  164.34,49.43 0 top
R22881  10K  [0201]  164.34,50.04 0 top
R22882  10K  [0201]  164.34,50.65 0 top
R22883  10K  [0201]  164.34,51.26 0 top
R22884  10K  [0201]  164.34,51.87 0 top
R22885  10K  [0201]  164.34,52.48 0 top
R22886  10K  [0201]  164.34,53.09 0 top
R22887  10K  [0201]  164.34,53.7 0 top
R22888  10K  [0201]  164.34,54.31 0 top
R22889  10K  [0201]  164.34,54.91 0 top
R22890  10K  [0201]  164.34,55.52 0 top
R22891  10K  [0201]  164.34,56.13 0 top
R22892  10K  [0201]  164.34,56.74 0 top
R22893  10K  [0201]  164.34,57.35 0 top
R22894  10K  [0201]  164.34,57.96 0 top
R22895  10K  [0201]  164.34,58.57 0 top
R22896  10K  [0201]  164.34,59.18 0 top
R22897  10K  [0201]  164.34,59.79 0 top
R22898  10K  [0201]  164.34,60.4 0 top
R22899  10K  [0201]  164.34,61.01 0 top
R22900  10K  [0201]  164.34,61.62 0 top
R22901  10K  [0201]  164.34,62.23 0 top
R22902  10K  [0201]  164.34,62.84 0 top
R22903  10K  [0201]  164.34,63.45 0 top
R22904  10K  [0201]  164.34,64.06 0 top
R22905  10K  [0201]  164.34,64.67 0 top
R22906  10K  [0201]  164.34,65.28 0 top
R22907  10K  [0201]  164.34,65.89 0 top
R22908  10K  [0201]  164.34,66.5 0 top
R22909  10K  [0201]  164.34,67.11 0 top
R22910  10K  [0201]  164.34,67.72 0 top
R22911  10K  [0201]  164.34,68.33 0 top
R22912  10K  [0201]  164.34,68.94 0 top
R22913  10K  [0201]  164.34,69.55 0 top
R22914  10K  [0201]  164.34,70.15 0 top
R22915  10K  [0201]  164.34,70.76 0 top
R22916  10K  [0201]  164.34,71.37 0 top
R22917  10K  [0201]  164.34,71.98 0 top
R22918  10K  [0201]  164.34,72.59 0 top
R22919  10K  [0201]  164.34,73.2 0 top
R22920  10K  [0201]  164.34,73.81 0 top
R22921  10K  [0201]  164.34,74.42 0 top
R22922  10K  [0201]  164.34,75.03 0 top
R22923  10K  [0201]  164.34,75.64 0 top
R22924  10K  [0201]  164.34,76.25 0 top
R22925  10K  [0201]  164.34,76.86 0 top
R22926  10K  [0201]  164.34,77.47 0 top
R22927  10K  [0201]  164.34,78.08 0 top
R22928  10K  [0201]  164.34,78.69 0 top
R22929  10K  [0201]  164.34,79.3 0 top
R22930  10K  [0201]  164.34,79.91 0 top
R22931  10K  [0201]  164.34,80.52 0 top
R22932  10K  [0201]  164.34,81.13 0 top
R22933  10K  [0201]  164.34,81.74 0 top
R22934  10K  [0201]  164.34,82.35 0 top
R22935  10K  [0201]  164.34,82.96 0 top
R22936  10K  [0201]  164.34,83.57 0 top
R22937  10K  [0201]  164.34,84.18 0 top
R22938  10K  [0201]  164.34,84.79 0 top
R22939  10K  [0201]  164.34,85.39 0 top
R22940  10K  [0201]  164.34,86 0 top
R22941  10K  [0201]  164.34,86.61 0 top
R22942  10K  [0201]  164.34,87.22 0 top
R22943  10K  [0201]  164.34,87.83 0 top
R22944  10K  [0201]  164.34,88.44 0 top
R22945  10K  [0201]  164.34,89.05 0 top
R22946  10K  [0201]  164.34,89.66 0 top
R22947  10K  [0201]  164.34,90.27 0 top
R22948  10K  [0201]  164.34,90.88 0 top
R22949  10K  [0201]  164.34,91.49 0 top
R22950  10K  [0201]  164.34,92.1 0 top
R22951  10K  [0201]  164.34,92.71 0 top
R22952  10K  [0201]  164.34,93.32 0 top
R22953  10K  [0201]  164.34,93.93 0 top
R22954  10K  [0201]  164.34,94.54 0 top
R22955  10K  [0201]  164.34,95.15 0 top
R22956  10K  [0201]  164.34,95.76 0 top
R22957  10K  [0201]  164.34,96.37 0 top
R22958  10K  [0201]  164.34,96.98 0 top
R22959  10K  [0201]  164.34,97.59 0 top
R22960  10K  [0201]  164.34,98.2 0 top
R22961  10K  [0201]  164.34,98.81 0 top
R22962  10K  [0201]  164.34,99.42 0 top
R22963  10K  [0201]  164.34,100.03 0 top
R22964  10K  [0201]  164.34,100.63 0 top
R22965  10K  [0201]  164.34,101.24 0 top
R22966  10K  [0201]  164.34,101.85 0 top
R22967  10K  [0201]  164.34,102.46 0 top
R22968  10K  [0201]  164.34,103.07 0 top
R22969  10K  [0201]  164.34,103.68 0 top
R22970  10K  [0201]  164.34,104.29 0 top
R22971  10K  [0201]  164.34,104.9 0 top
R22972  10K  [0201]  164.34,105.51 0 top
R22973  10K  [0201]  164.34,106.12 0 top
R22974  10K  [0201]  164.34,106.73 0 top
R22975  10K  [0201]  164.34,107.34 0 top
R22976  10K  [0201]  164.34,107.95 0 top